# EasyEDA Pro project Project_first.eprj, schematic Schematic9

## Sheets
1 mcu_复位电路错误: Create Date: 2024-06-17; Page Name: mcu_复位电路错误; Project Name: Project_first; Schematic Name: Schematic9; Update Date: 2024-06-19; Company: 嘉立创EDA; Page Size: A4; Version: V1.0
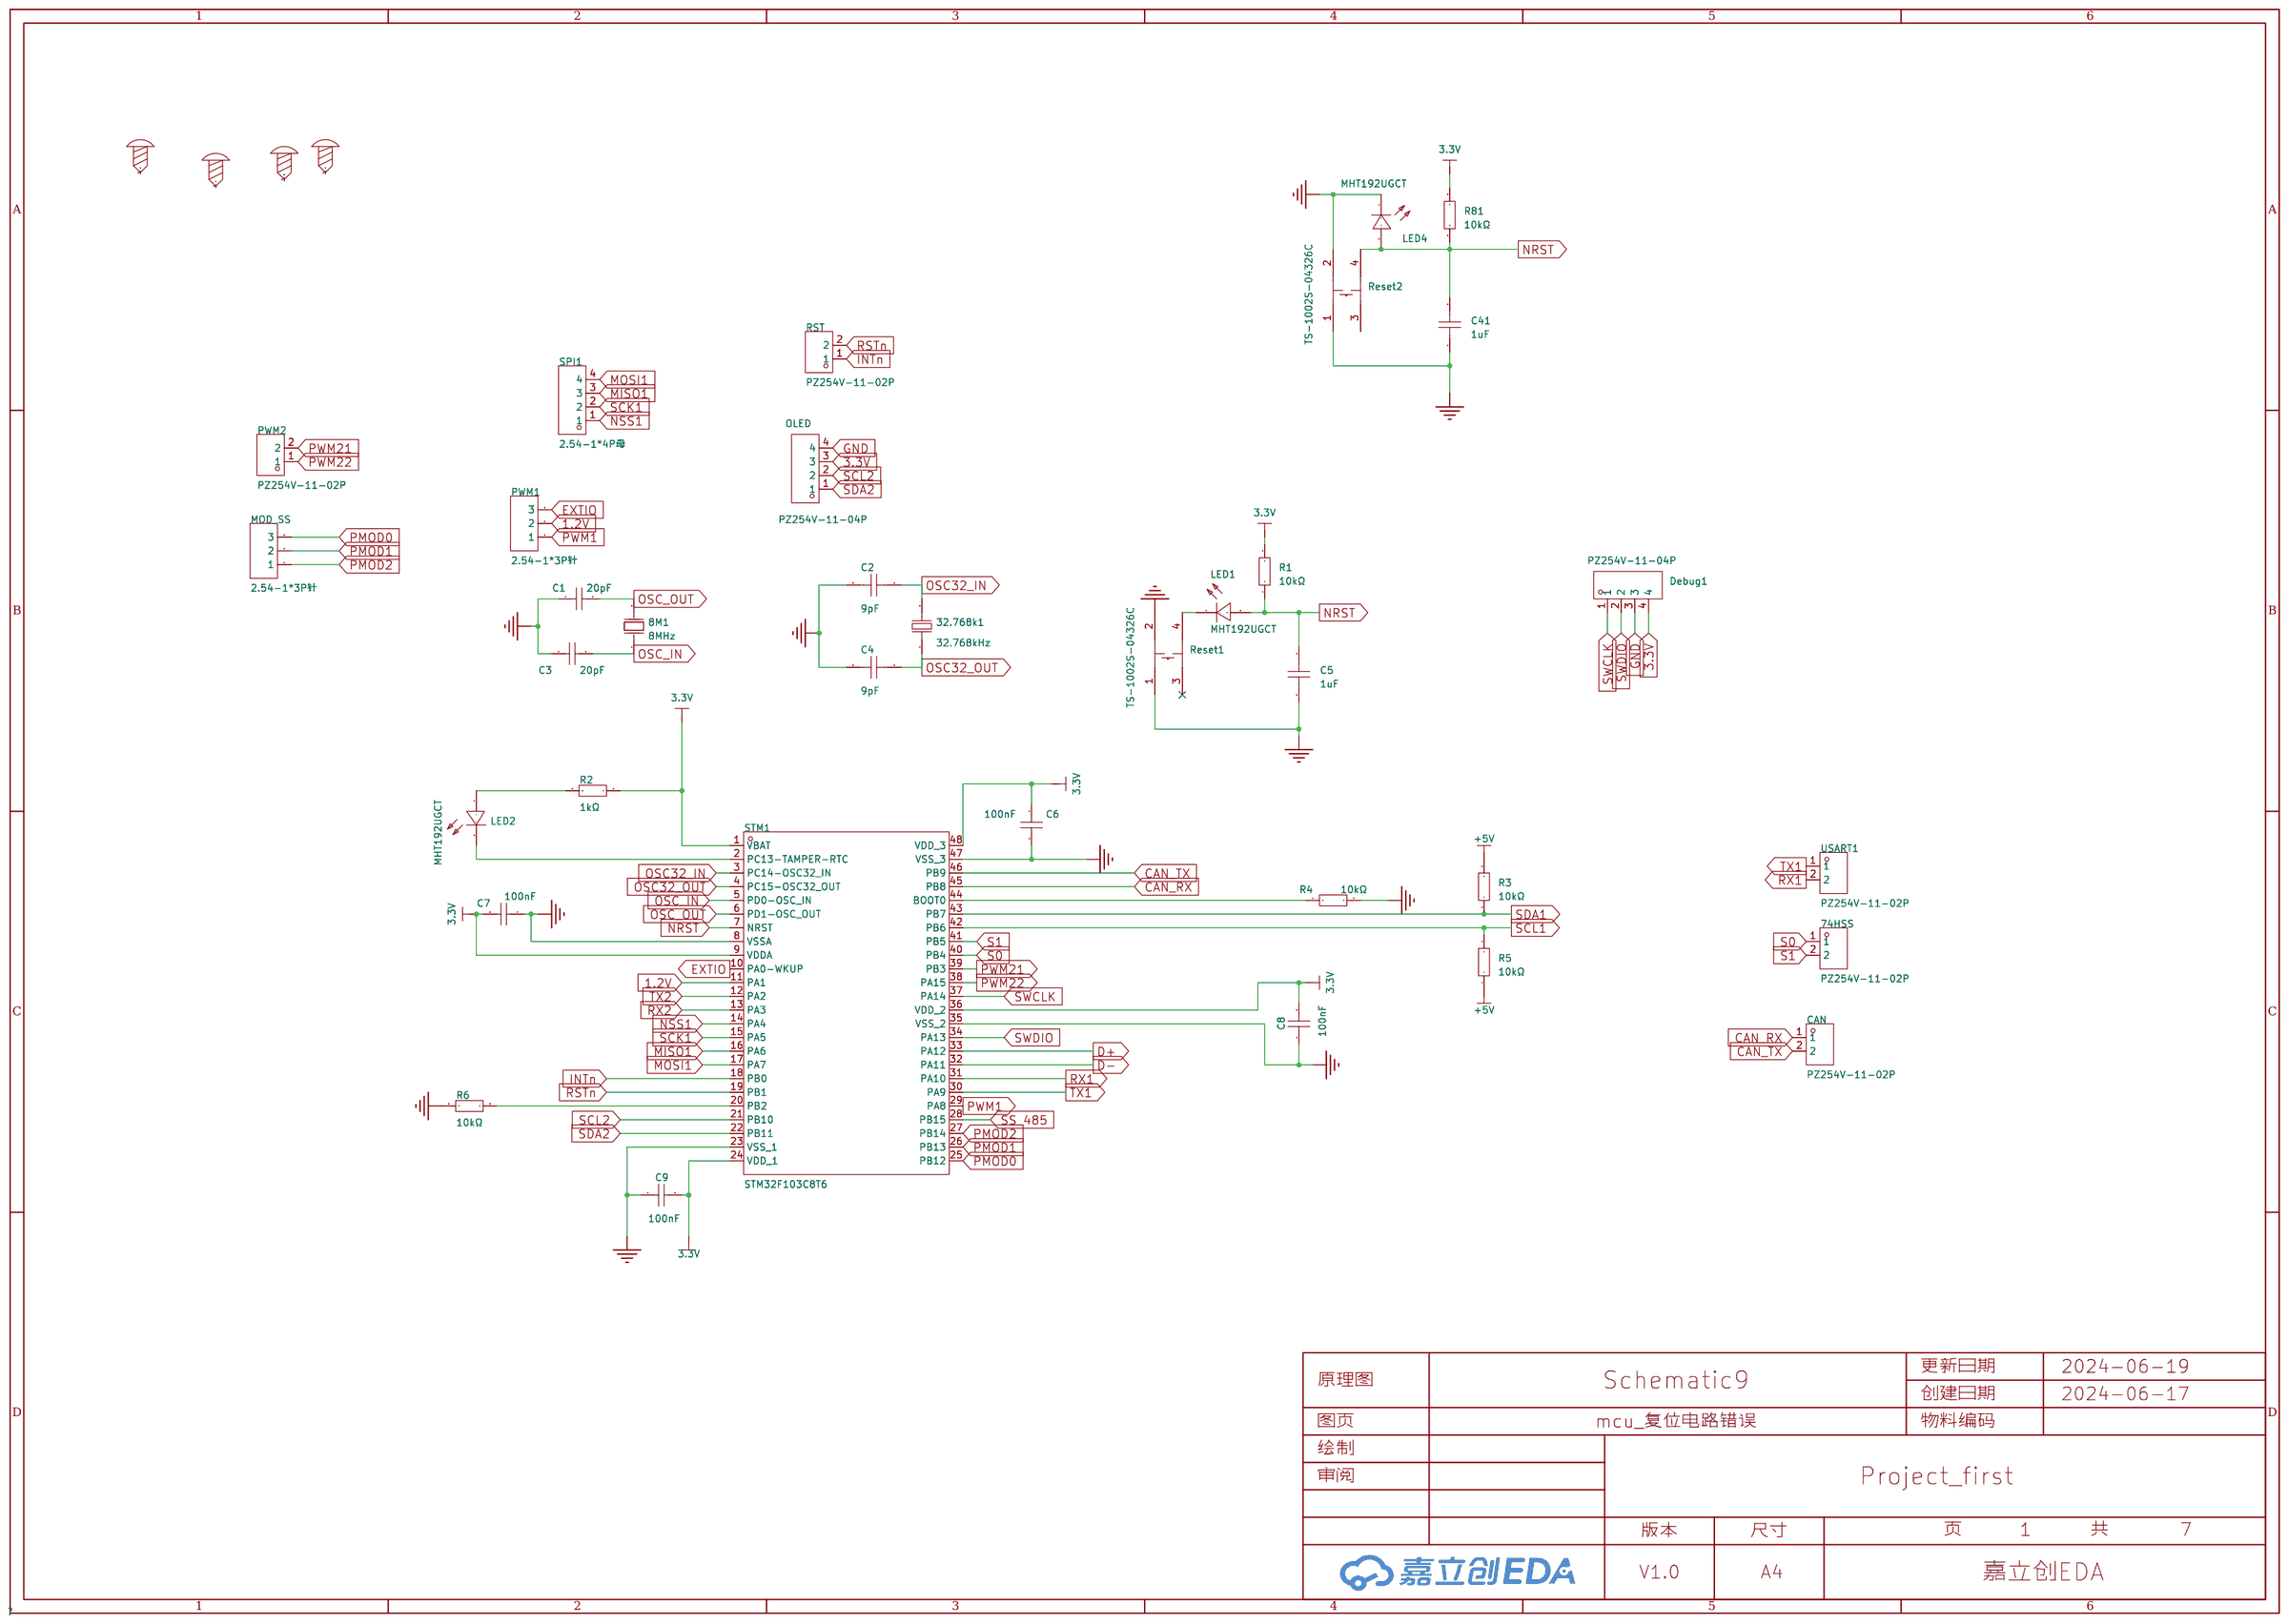
[diagram p10: mcu_复位电路错误]
2 w5500: Create Date: 2024-06-18; Page Name: w5500
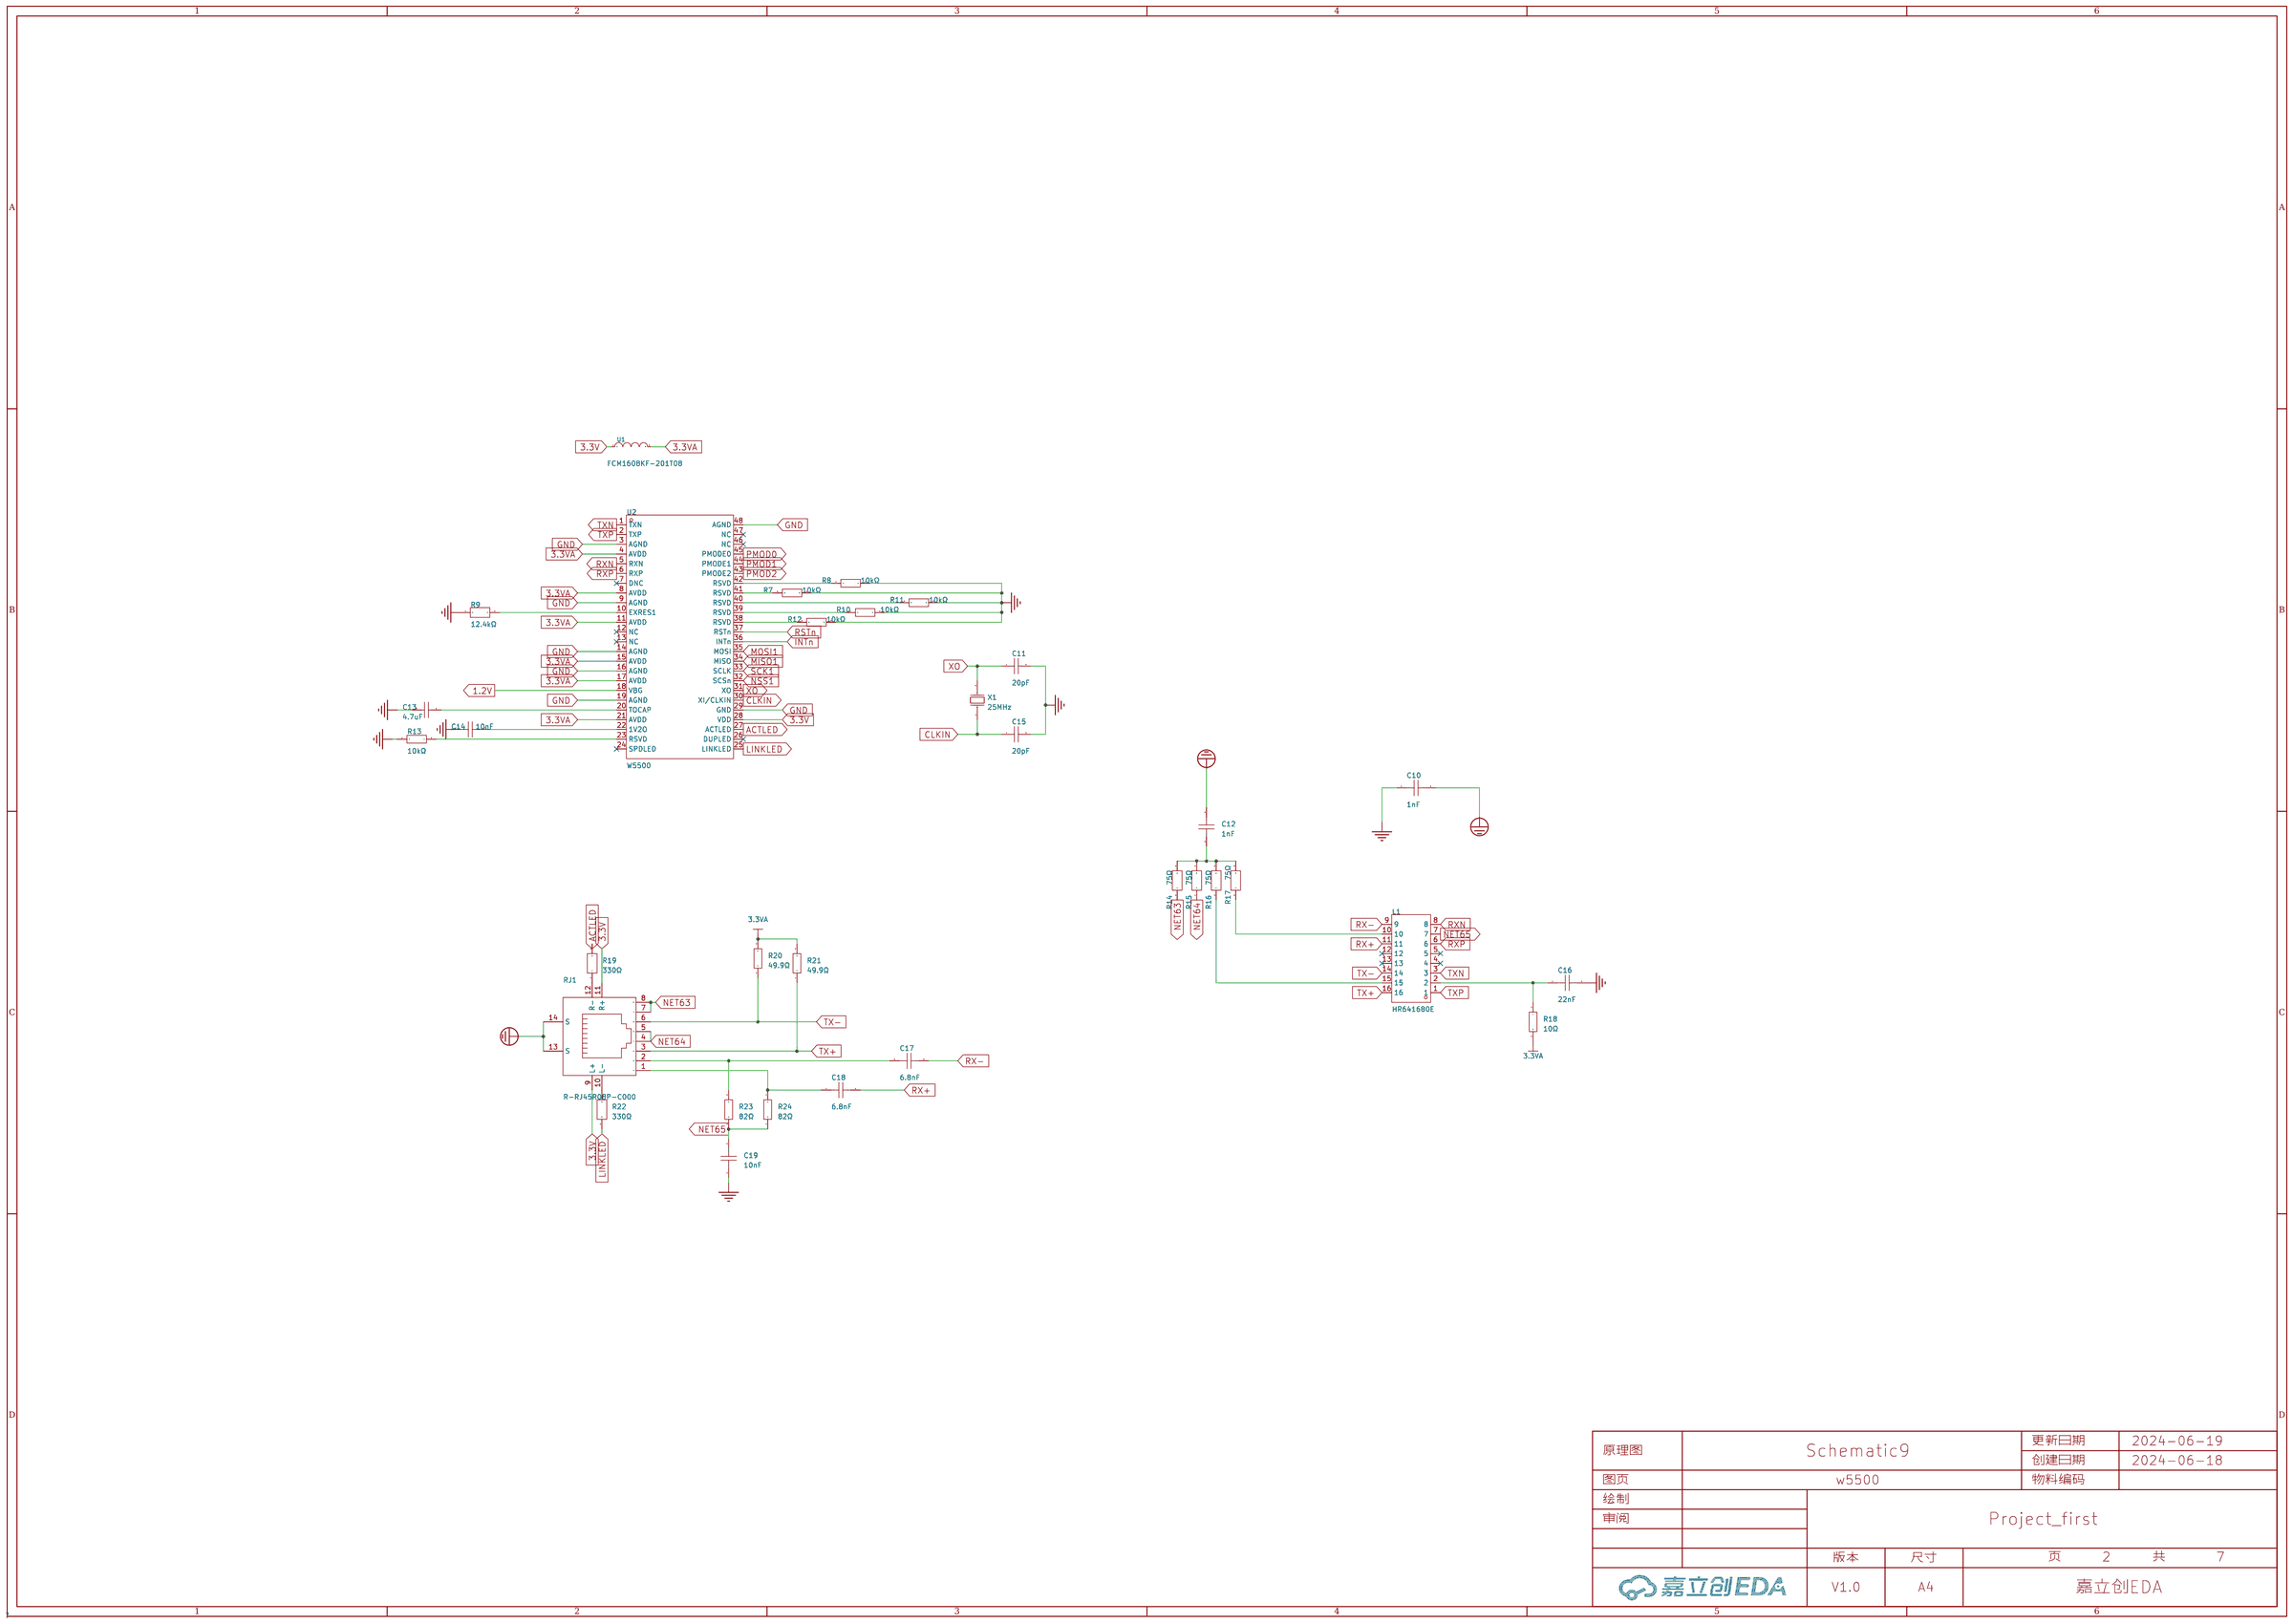
[diagram p11: w5500]
3 差分电压: Create Date: 2024-06-18; Page Name: 差分电压
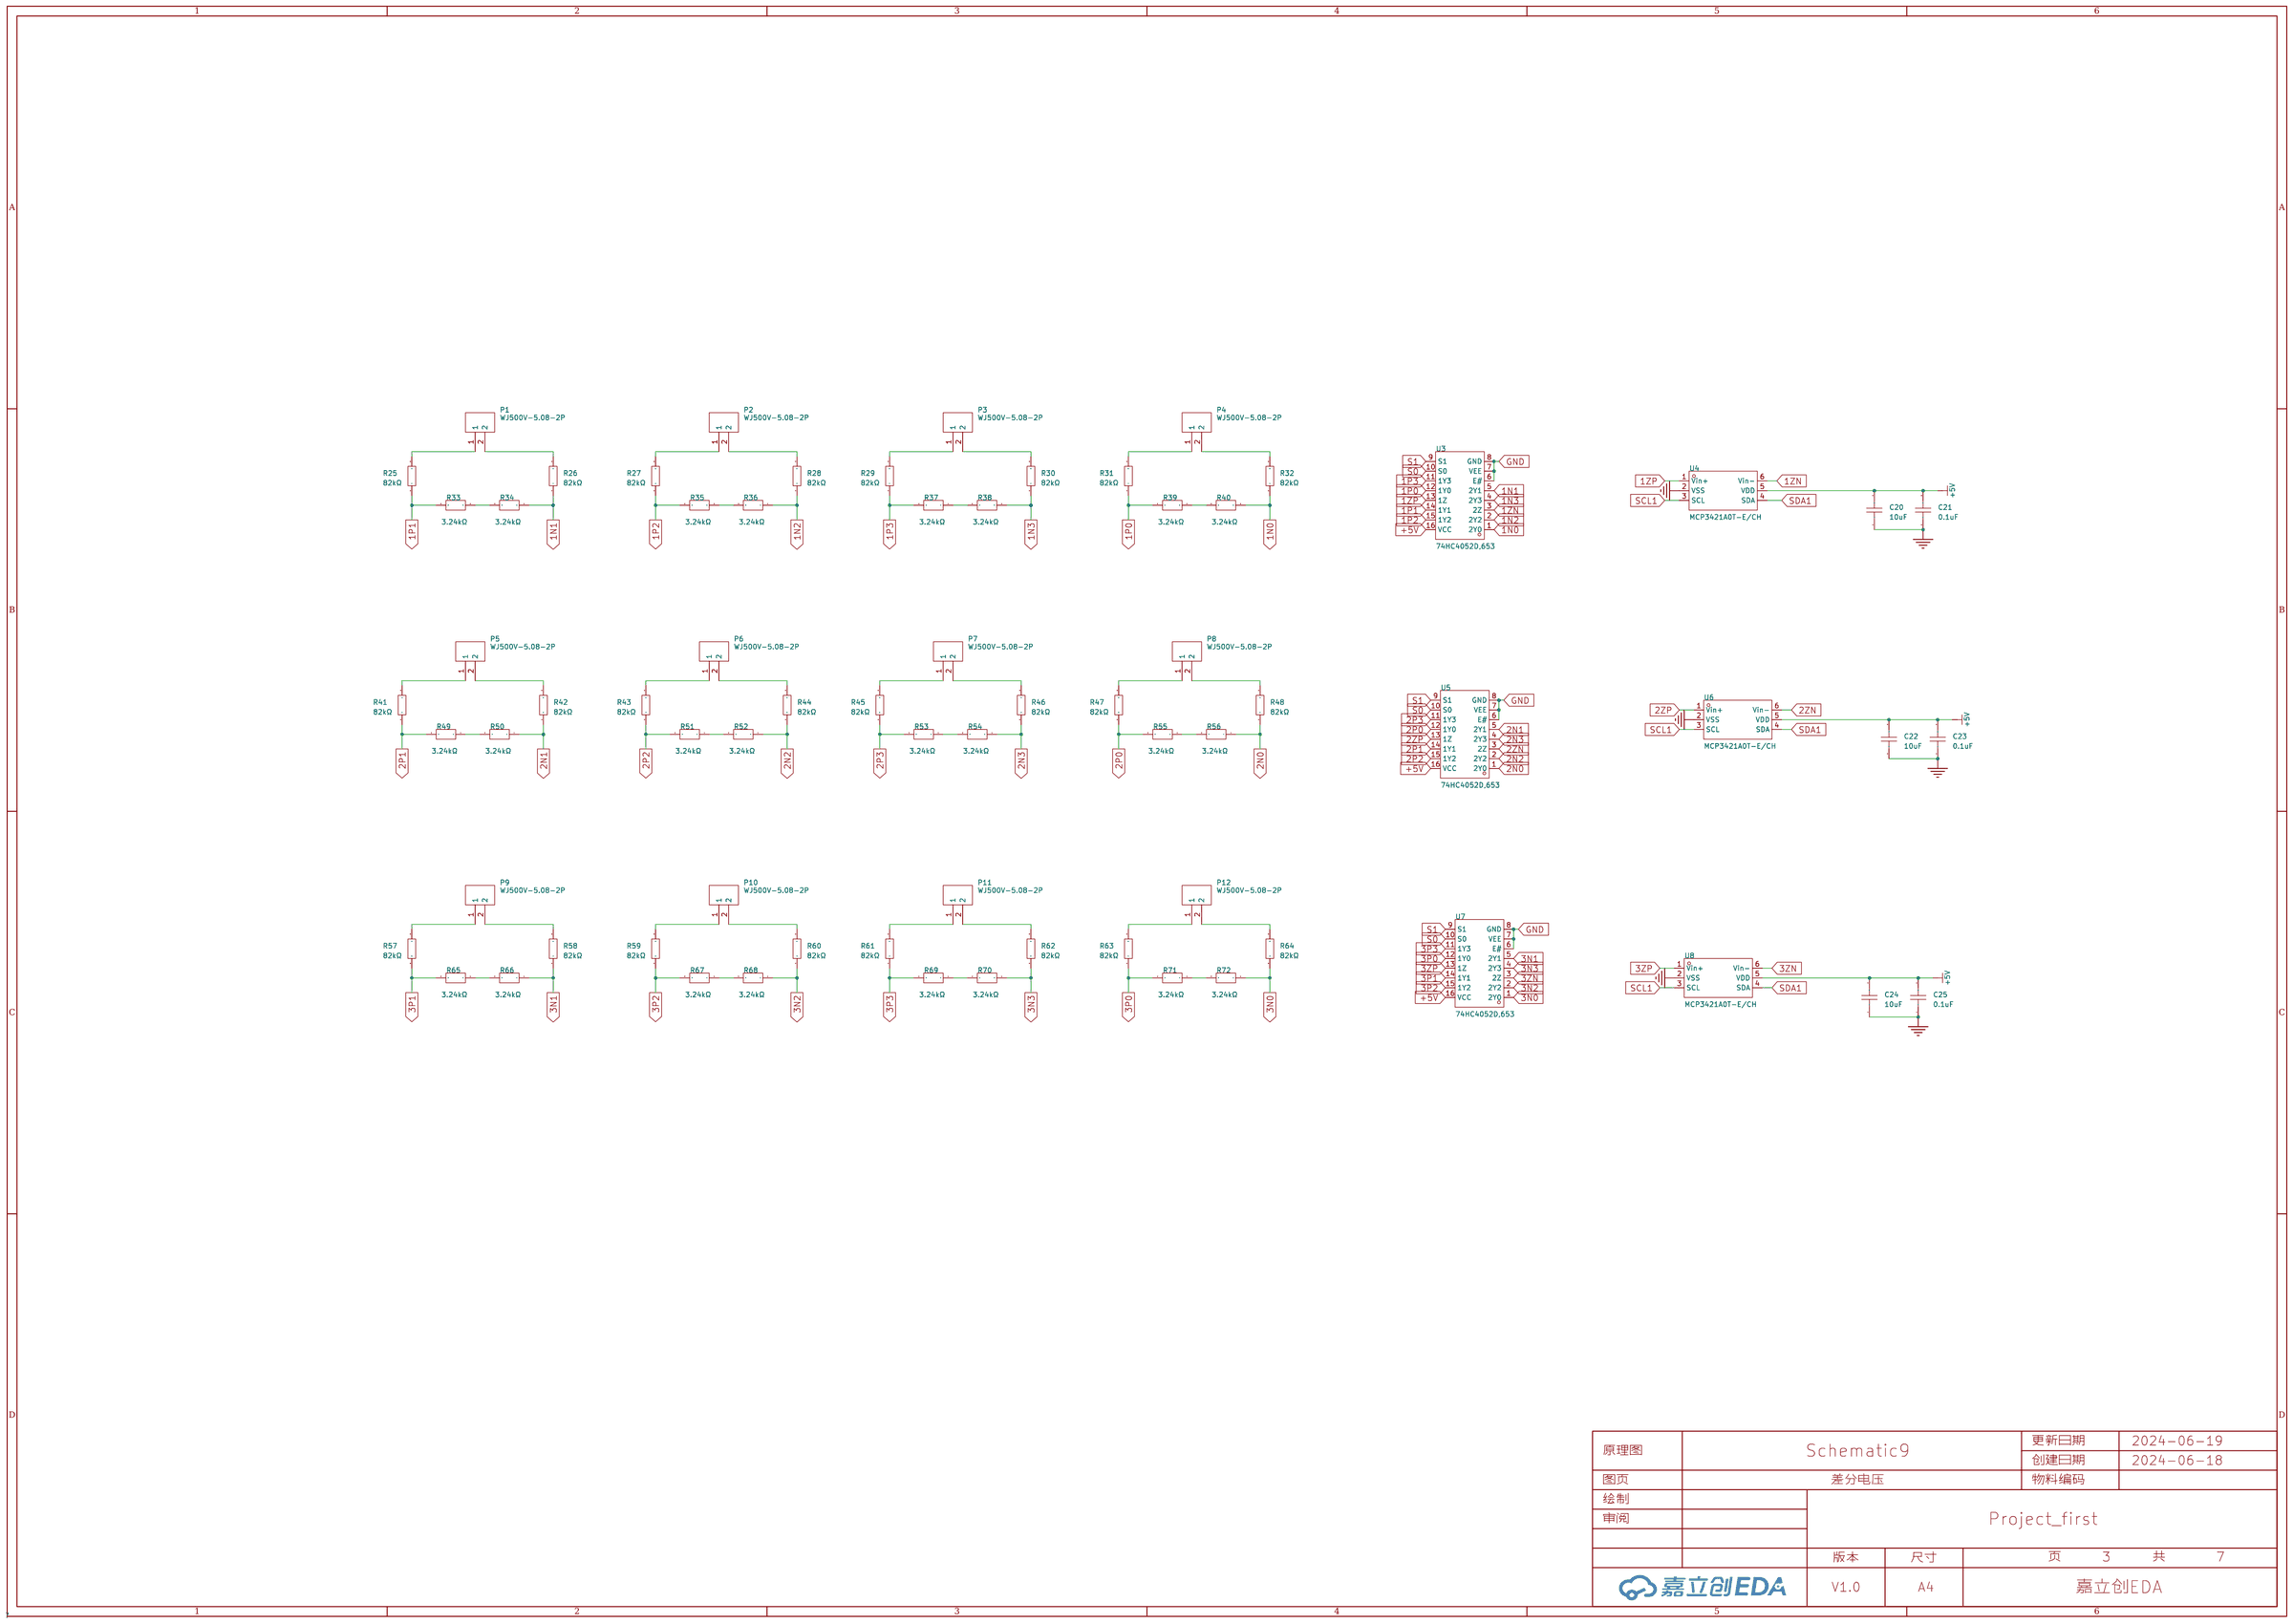
[diagram p12: 差分电压]
4 电源: Create Date: 2024-06-18; Page Name: 电源